# EasyEDA Pro project balance_car.eprj, schematic Schematic4
Board Name: 6_循迹_1; Create Date: 2024-08-19
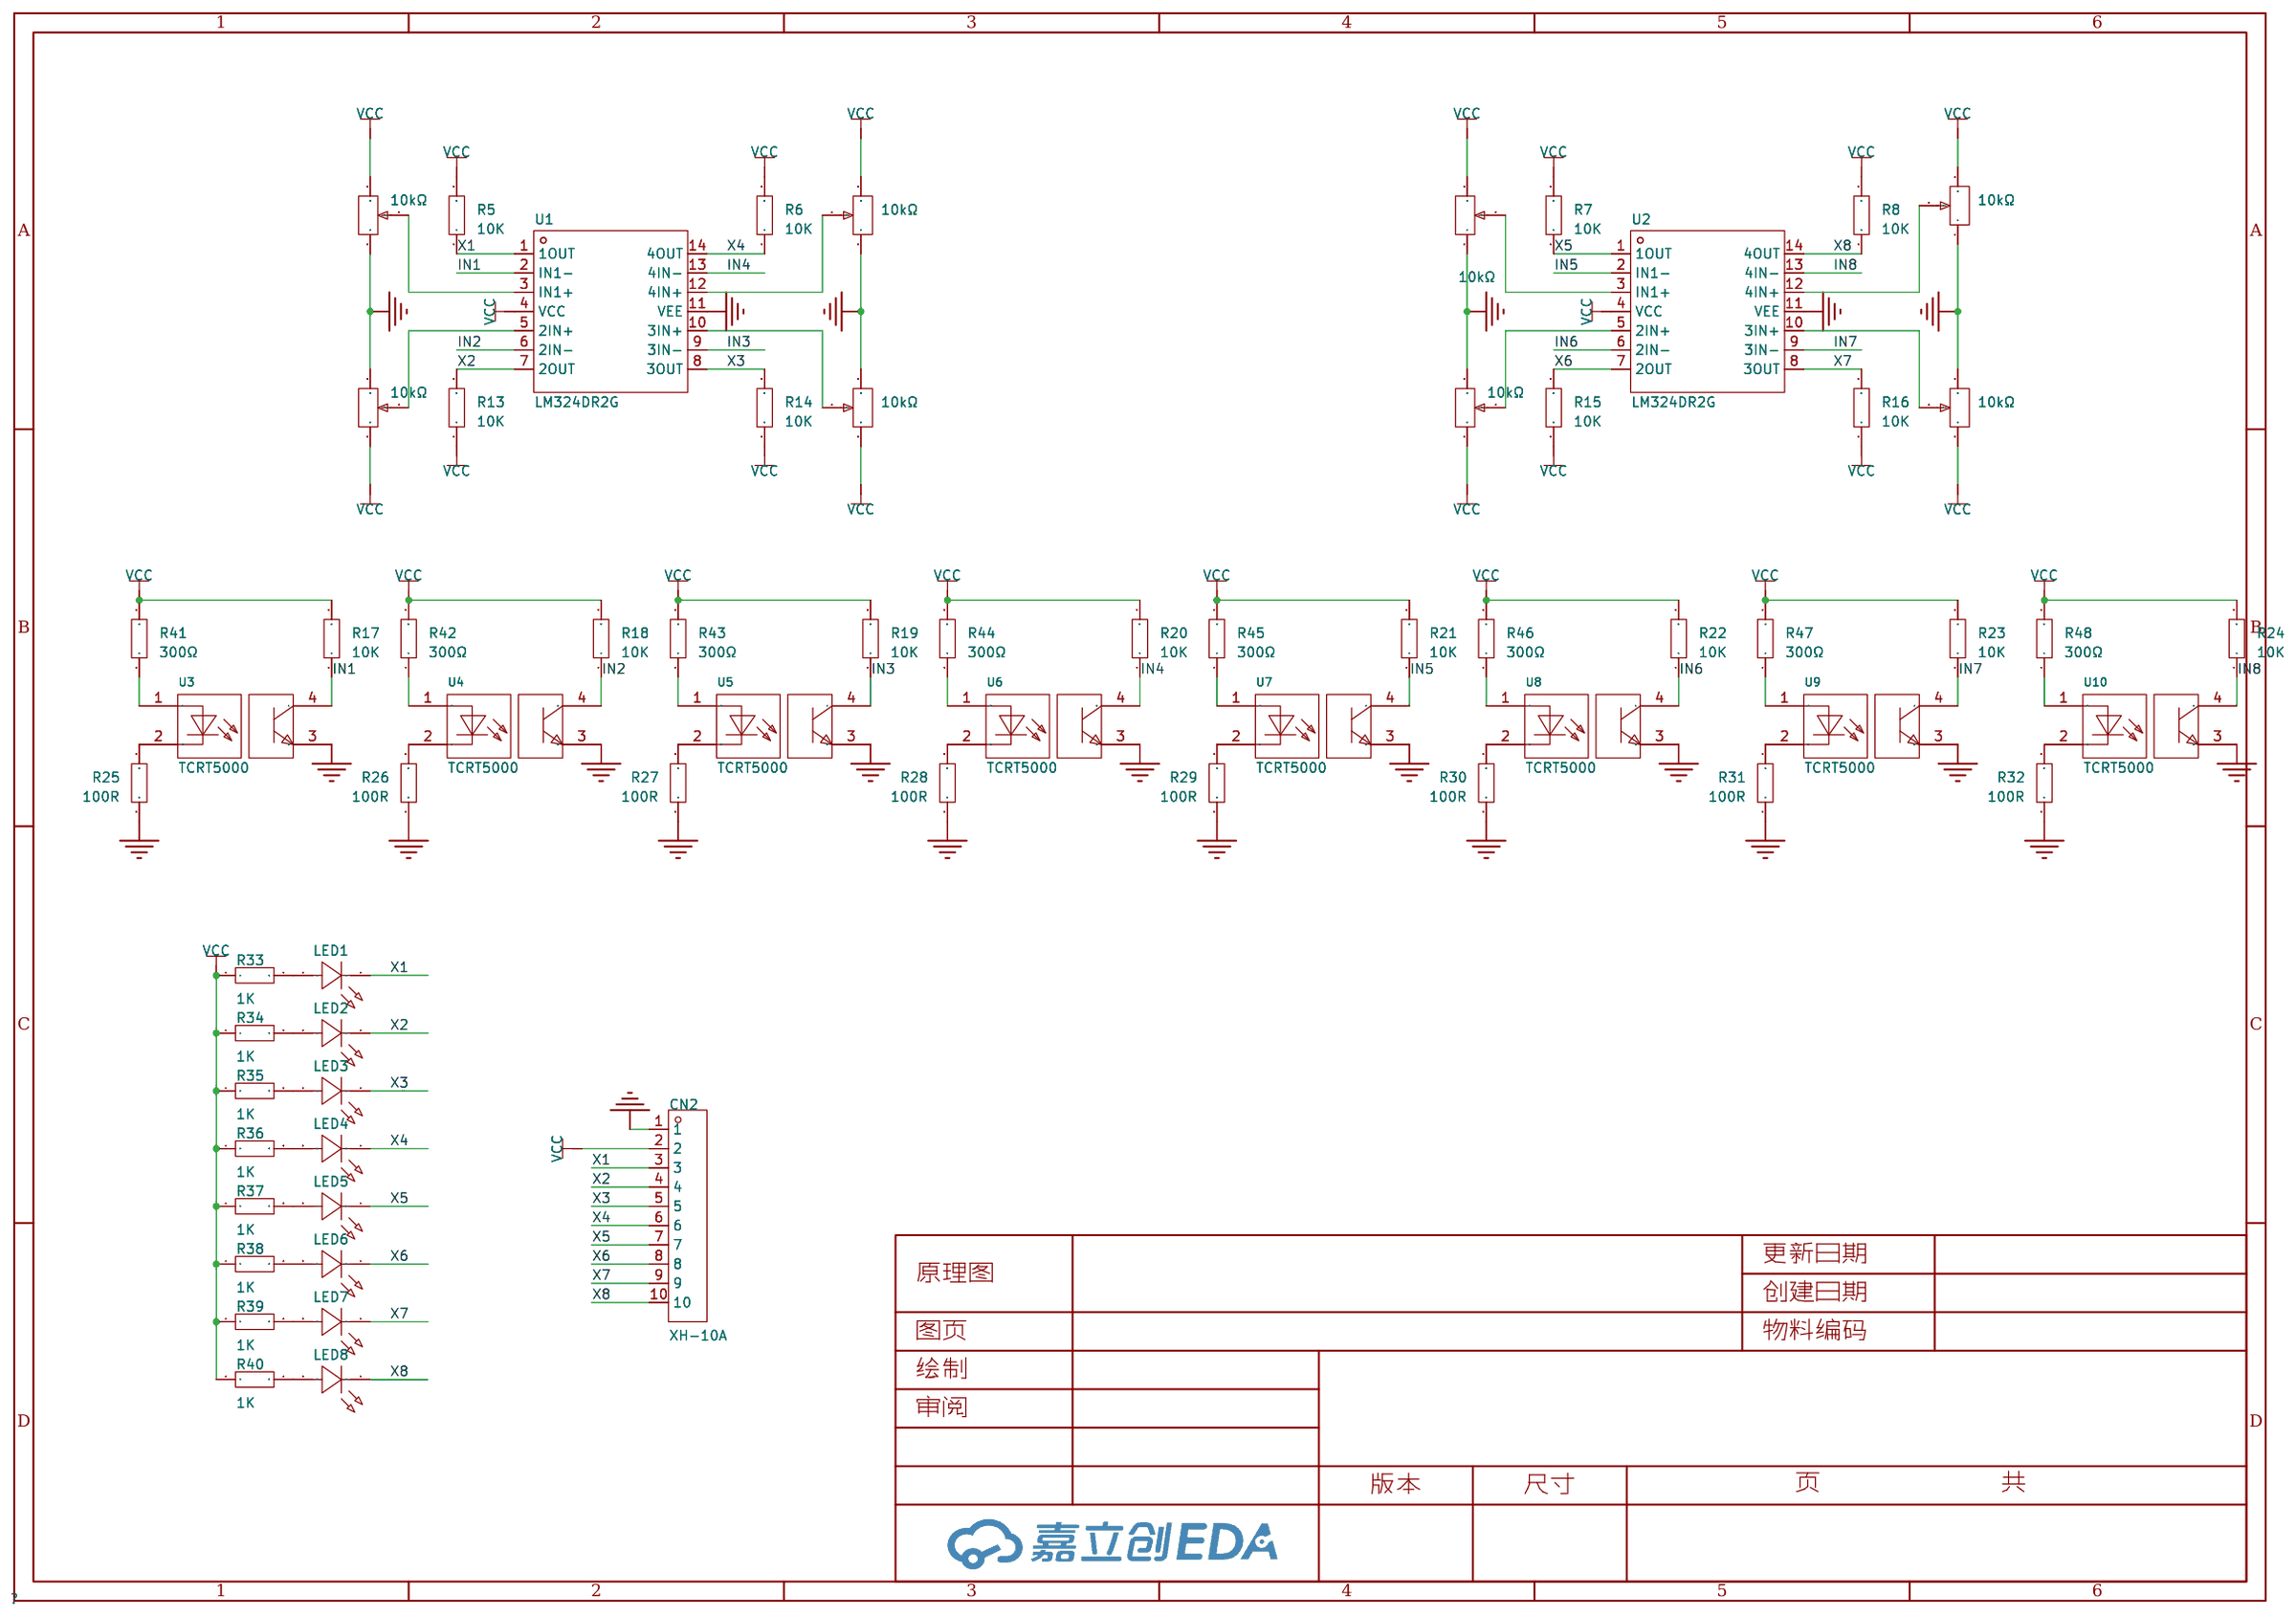
[diagram p2: schematic sheet]

## Parts
CN2  XH-10A  [CONN-TH_10P-P2.50_HCTL_XH-10A]
LED1  XL-2012SURC  [LED0805-RD_RED]
LED2  XL-2012SURC  [LED0805-RD_RED]
LED3  XL-2012SURC  [LED0805-RD_RED]
LED4  XL-2012SURC  [LED0805-RD_RED]
LED5  XL-2012SURC  [LED0805-RD_RED]
LED6  XL-2012SURC  [LED0805-RD_RED]
LED7  XL-2012SURC  [LED0805-RD_RED]
LED8  XL-2012SURC  [LED0805-RD_RED]
R5  10K  [R0603]
R6  10K  [R0603]
R7  10K  [R0603]
R8  10K  [R0603]
R13  10K  [R0603]
R14  10K  [R0603]
R15  10K  [R0603]
R16  10K  [R0603]
R17  10K  [R0603]
R18  10K  [R0603]
R19  10K  [R0603]
R20  10K  [R0603]
R21  10K  [R0603]
R22  10K  [R0603]
R23  10K  [R0603]
R24  10K  [R0603]
R25  100R  [R0603]
R26  100R  [R0603]
R27  100R  [R0603]
R28  100R  [R0603]
R29  100R  [R0603]
R30  100R  [R0603]
R31  100R  [R0603]
R32  100R  [R0603]
R33  1K  [R0603]
R34  1K  [R0603]
R35  1K  [R0603]
R36  1K  [R0603]
R37  1K  [R0603]
R38  1K  [R0603]
R39  1K  [R0603]
R40  1K  [R0603]
R41  300Ω  [R0603]
R42  300Ω  [R0603]
R43  300Ω  [R0603]
R44  300Ω  [R0603]
R45  300Ω  [R0603]
R46  300Ω  [R0603]
R47  300Ω  [R0603]
R48  300Ω  [R0603]
U1  LM324DR2G  [SOIC-14_L8.7-W3.9-P1.27-LS6.0-BL]
U2  LM324DR2G  [SOIC-14_L8.7-W3.9-P1.27-LS6.0-BL]
U3  TCRT5000  [OPTO-TH_TCRT5000]
U4  TCRT5000  [OPTO-TH_TCRT5000]
U5  TCRT5000  [OPTO-TH_TCRT5000]
U6  TCRT5000  [OPTO-TH_TCRT5000]
U7  TCRT5000  [OPTO-TH_TCRT5000]
U8  TCRT5000  [OPTO-TH_TCRT5000]
U9  TCRT5000  [OPTO-TH_TCRT5000]
U10  TCRT5000  [OPTO-TH_TCRT5000]
VR1  10kΩ  [RES-ADJ-TH_3362P]
VR2  10kΩ  [RES-ADJ-TH_3362P]
VR3  10kΩ  [RES-ADJ-TH_3362P]
VR4  10kΩ  [RES-ADJ-TH_3362P]
VR5  10kΩ  [RES-ADJ-TH_3362P]
VR6  10kΩ  [RES-ADJ-TH_3362P]
VR7  10kΩ  [RES-ADJ-TH_3362P]
VR8  10kΩ  [RES-ADJ-TH_3362P]

## Library data of the parts
CN2 = XH-10A: LCSC Part Name: 1x10P 间距:2.5mm 直插 系列:XH; Supplier Part: C2908608; Manufacturer: HCTL(华灿天禄); Supplier Footprint: 插件,P=2.5mm; JLCPCB Part Class: 扩展库; Datasheet: https://atta.szlcsc.com/upload/public/pdf/source/20230711/68D365716984B4AFE576D1D73D61B465.pdf; Supplier: LCSC; Pins Structure: 1x10P; Pitch: 2.5mm; Mounting Style: 直插; Reference Series: XH; Number of Pins: 10P; Number of Rows: 1; Number of PINs Per Row: 10; Current Rating (Max): 3A; Contact Material: 黄铜; Contact Plating: 锡; Operating Temperature Range: -25℃~+85℃
LED1-LED8 = XL-2012SURC: 发光颜色:红灯;主波长:617nm~621nm;色温:-;功率:55mW;安装方式:正贴;; LCSC Part Name: 红灯 正贴; Supplier Part: C965812; Manufacturer: XINGLIGHT(成兴光); Supplier Footprint: 0805; JLCPCB Part Class: 扩展库; Datasheet: https://atta.szlcsc.com/upload/public/pdf/source/20221102/49E1A0A365644091E6270AF1C5E0FE37.pdf; Supplier: LCSC; Emitted Color: 红灯; Lens Color: 无色透明; Dominant Wavelength: 617nm~621nm; Peak Wavelength: 623nm; Forward Current: 25mA; Power Dissipation: 55mW; Viewing Angle: 120°; Mounting Sytle: 正贴; Operating Temperature: -30℃~+85℃
R5-R8 R13-R40 = Res_0603: Supplier Footprint: 0603
R41-R48 = 0603WAF3000T5E: LCSC Part Name: 300Ω ±1% 100mW 厚膜电阻; Supplier Part: C23025; Manufacturer: UNI-ROYAL(厚声); Supplier Footprint: 0603; JLCPCB Part Class: 基础库; Datasheet: https://atta.szlcsc.com/upload/public/pdf/source/20200306/C422600_1E6D84923E4A46A82E41ADD87F860B5C.pdf; Supplier: LCSC; Type: 厚膜电阻; Tolerance: ±1%; Power(Watts): 100mW; Overload Voltage (Max): 75V; Temperature Coefficient: ±100ppm/℃; Operating Temperature Range: -55℃~+155℃
U1 U2 = LM324DR2G: 放大器组数:4;带宽(-3db):-;输入偏置电流(Ib):90nA;增益带宽积(GBP):1MHz;压摆率(SR):-;; LCSC Part Name: 运算放大器，单电源，四路; Supplier Part: C63820; Manufacturer: onsemi(安森美); Supplier Footprint: SOP-14; JLCPCB Part Class: 扩展库; Datasheet: https://atta.szlcsc.com/upload/public/pdf/source/20151126/1457707597351.pdf; Supplier: LCSC; Number of Circuits: 4; Current - Input Bias(Ib): 90nA; Gain Bandwidth Product(GBP): 1MHz; Output Current: 40mA; Supply Current: 1.4mA; Operating Temperature: 0℃~+70℃
U3-U10 = TCRT5000: Supplier Part: C2984661; Manufacturer: VISHAY(威世); Supplier Footprint: DIP-4; JLCPCB Part Class: 扩展库; Datasheet: https://atta.szlcsc.com/upload/public/pdf/source/20220524/56309200CFD992CFE90087BA59F1182D.pdf; Supplier: LCSC
VR1-VR8 = 3362P-1-103LF: LCSC Part Name: 10kΩ ±10%; Supplier Part: C58159; Manufacturer: BOURNS; Supplier Footprint: 插件-3P,7x6.6mm; JLCPCB Part Class: 扩展库; Datasheet: https://atta.szlcsc.com/upload/public/pdf/source/20160823/1471947545189.pdf; Supplier: LCSC; Tolerance: ±10%; Power(Watts): 500mW; Temperature Coefficient: ±100ppm/℃; Turns: 1

## Nets
GND: CN2.1 R25.1 R26.1 R27.1 R28.1 R29.1 R30.1 R31.1 R32.1 U1.11(VEE) U2.11(VEE) U3.3 U4.3 U5.3 U6.3 U7.3 U8.3 U9.3 U10.3 VR1.1 VR2.3 VR3.1 VR4.3 VR5.1 VR6.3 VR7.1 VR8.3
VCC: CN2.2 R5.2 R6.2 R7.2 R8.2 R13.1 R14.1 R15.1 R16.1 R17.2 R18.2 R19.2 R20.2 R21.2 R22.2 R23.2 R24.2 R33.1 R34.1 R35.1 R36.1 R37.1 R38.1 R39.1 R40.1 R41.2 R42.2 R43.2 R44.2 R45.2 R46.2 R47.2 R48.2 U1.4(VCC) U2.4(VCC) VR1.3 VR2.1 VR3.3 VR4.1 VR5.3 VR6.1 VR7.3 VR8.1
IN1: R17.1 U1.2(IN1-) U3.4
IN2: R18.1 U1.6(2IN-) U4.4
IN3: R19.1 U1.9(3IN-) U5.4
IN4: R20.1 U1.13(4IN-) U6.4
IN5: R21.1 U2.2(IN1-) U7.4
IN6: R22.1 U2.6(2IN-) U8.4
IN7: R23.1 U2.9(3IN-) U9.4
IN8: R24.1 U2.13(4IN-) U10.4
X1: CN2.3 LED1.1(K) R5.1 U1.1(1OUT)
X2: CN2.4 LED2.1(K) R13.2 U1.7(2OUT)
X3: CN2.5 LED3.1(K) R14.2 U1.8(3OUT)
X4: CN2.6 LED4.1(K) R6.1 U1.14(4OUT)
X5: CN2.7 LED5.1(K) R7.1 U2.1(1OUT)
X6: CN2.8 LED6.1(K) R15.2 U2.7(2OUT)
X7: CN2.9 LED7.1(K) R16.2 U2.8(3OUT)
X8: CN2.10 LED8.1(K) R8.1 U2.14(4OUT)
$1N2581: U1.3(IN1+) VR1.2
$1N2582: U1.5(2IN+) VR2.2
$1N2583: U1.10(3IN+) VR4.2
$1N2584: U1.12(4IN+) VR3.2
$1N2611: U2.3(IN1+) VR5.2
$1N2612: U2.5(2IN+) VR6.2
$1N2613: U2.10(3IN+) VR8.2
$1N2614: U2.12(4IN+) VR7.2
$1N2615: LED1.2(A) R33.2
$1N2616: LED2.2(A) R34.2
$1N2617: LED3.2(A) R35.2
$1N2618: LED4.2(A) R36.2
$1N2652: LED7.2(A) R39.2
$1N2653: LED8.2(A) R40.2
$1N2654: R25.2 U3.2
$1N2660: R26.2 U4.2
$1N2666: R27.2 U5.2
$1N2672: R28.2 U6.2
$1N2678: R29.2 U7.2
$1N2684: R30.2 U8.2
$1N2690: R31.2 U9.2
$1N2696: R32.2 U10.2
$1N2698: LED6.2(A) R38.2
$1N2699: LED5.2(A) R37.2
$1N4632: R41.1 U3.1
$1N4675: R42.1 U4.1
$1N4718: R43.1 U5.1
$1N4761: R44.1 U6.1
$1N4804: R45.1 U7.1
$1N4847: R46.1 U8.1
$1N4890: R47.1 U9.1
$1N4930: R48.1 U10.1
